# EAGLE schematic Resistor_Resistor (EAGLE 8.3.0), part 28 of 43
## Parts (continued)
R38638  10K  RESISTOR_0201  [0201]
R38639  10K  RESISTOR_0201  [0201]
R38640  10K  RESISTOR_0201  [0201]
R38641  10K  RESISTOR_0201  [0201]
R38642  10K  RESISTOR_0201  [0201]
R38643  10K  RESISTOR_0201  [0201]
R38644  10K  RESISTOR_0201  [0201]
R38645  10K  RESISTOR_0201  [0201]
R38646  10K  RESISTOR_0201  [0201]
R38647  10K  RESISTOR_0201  [0201]
R38648  10K  RESISTOR_0201  [0201]
R38649  10K  RESISTOR_0201  [0201]
R38650  10K  RESISTOR_0201  [0201]
R38651  10K  RESISTOR_0201  [0201]
R38652  10K  RESISTOR_0201  [0201]
R38653  10K  RESISTOR_0201  [0201]
R38654  10K  RESISTOR_0201  [0201]
R38655  10K  RESISTOR_0201  [0201]
R38656  10K  RESISTOR_0201  [0201]
R38657  10K  RESISTOR_0201  [0201]
R38658  10K  RESISTOR_0201  [0201]
R38659  10K  RESISTOR_0201  [0201]
R38660  10K  RESISTOR_0201  [0201]
R38661  10K  RESISTOR_0201  [0201]
R38662  10K  RESISTOR_0201  [0201]
R38663  10K  RESISTOR_0201  [0201]
R38664  10K  RESISTOR_0201  [0201]
R38665  10K  RESISTOR_0201  [0201]
R38666  10K  RESISTOR_0201  [0201]
R38667  10K  RESISTOR_0201  [0201]
R38668  10K  RESISTOR_0201  [0201]
R38669  10K  RESISTOR_0201  [0201]
R38670  10K  RESISTOR_0201  [0201]
R38671  10K  RESISTOR_0201  [0201]
R38672  10K  RESISTOR_0201  [0201]
R38673  10K  RESISTOR_0201  [0201]
R38674  10K  RESISTOR_0201  [0201]
R38675  10K  RESISTOR_0201  [0201]
R38676  10K  RESISTOR_0201  [0201]
R38677  10K  RESISTOR_0201  [0201]
R38678  10K  RESISTOR_0201  [0201]
R38679  10K  RESISTOR_0201  [0201]
R38680  10K  RESISTOR_0201  [0201]
R38681  10K  RESISTOR_0201  [0201]
R38682  10K  RESISTOR_0201  [0201]
R38683  10K  RESISTOR_0201  [0201]
R38684  10K  RESISTOR_0201  [0201]
R38685  10K  RESISTOR_0201  [0201]
R38686  10K  RESISTOR_0201  [0201]
R38687  10K  RESISTOR_0201  [0201]
R38688  10K  RESISTOR_0201  [0201]
R38689  10K  RESISTOR_0201  [0201]
R38690  10K  RESISTOR_0201  [0201]
R38691  10K  RESISTOR_0201  [0201]
R38692  10K  RESISTOR_0201  [0201]
R38693  10K  RESISTOR_0201  [0201]
R38694  10K  RESISTOR_0201  [0201]
R38695  10K  RESISTOR_0201  [0201]
R38696  10K  RESISTOR_0201  [0201]
R38697  10K  RESISTOR_0201  [0201]
R38698  10K  RESISTOR_0201  [0201]
R38699  10K  RESISTOR_0201  [0201]
R38700  10K  RESISTOR_0201  [0201]
R38701  10K  RESISTOR_0201  [0201]
R38702  10K  RESISTOR_0201  [0201]
R38703  10K  RESISTOR_0201  [0201]
R38704  10K  RESISTOR_0201  [0201]
R38705  10K  RESISTOR_0201  [0201]
R38706  10K  RESISTOR_0201  [0201]
R38707  10K  RESISTOR_0201  [0201]
R38708  10K  RESISTOR_0201  [0201]
R38709  10K  RESISTOR_0201  [0201]
R38710  10K  RESISTOR_0201  [0201]
R38711  10K  RESISTOR_0201  [0201]
R38712  10K  RESISTOR_0201  [0201]
R38713  10K  RESISTOR_0201  [0201]
R38714  10K  RESISTOR_0201  [0201]
R38715  10K  RESISTOR_0201  [0201]
R38716  10K  RESISTOR_0201  [0201]
R38717  10K  RESISTOR_0201  [0201]
R38718  10K  RESISTOR_0201  [0201]
R38719  10K  RESISTOR_0201  [0201]
R38720  10K  RESISTOR_0201  [0201]
R38721  10K  RESISTOR_0201  [0201]
R38722  10K  RESISTOR_0201  [0201]
R38723  10K  RESISTOR_0201  [0201]
R38724  10K  RESISTOR_0201  [0201]
R38725  10K  RESISTOR_0201  [0201]
R38726  10K  RESISTOR_0201  [0201]
R38727  10K  RESISTOR_0201  [0201]
R38728  10K  RESISTOR_0201  [0201]
R38729  10K  RESISTOR_0201  [0201]
R38730  10K  RESISTOR_0201  [0201]
R38731  10K  RESISTOR_0201  [0201]
R38732  10K  RESISTOR_0201  [0201]
R38733  10K  RESISTOR_0201  [0201]
R38734  10K  RESISTOR_0201  [0201]
R38735  10K  RESISTOR_0201  [0201]
R38736  10K  RESISTOR_0201  [0201]
R38737  10K  RESISTOR_0201  [0201]
R38738  10K  RESISTOR_0201  [0201]
R38739  10K  RESISTOR_0201  [0201]
R38740  10K  RESISTOR_0201  [0201]
R38741  10K  RESISTOR_0201  [0201]
R38742  10K  RESISTOR_0201  [0201]
R38743  10K  RESISTOR_0201  [0201]
R38744  10K  RESISTOR_0201  [0201]
R38745  10K  RESISTOR_0201  [0201]
R38746  10K  RESISTOR_0201  [0201]
R38747  10K  RESISTOR_0201  [0201]
R38748  10K  RESISTOR_0201  [0201]
R38749  10K  RESISTOR_0201  [0201]
R38750  10K  RESISTOR_0201  [0201]
R38751  10K  RESISTOR_0201  [0201]
R38752  10K  RESISTOR_0201  [0201]
R38753  10K  RESISTOR_0201  [0201]
R38754  10K  RESISTOR_0201  [0201]
R38755  10K  RESISTOR_0201  [0201]
R38756  10K  RESISTOR_0201  [0201]
R38757  10K  RESISTOR_0201  [0201]
R38758  10K  RESISTOR_0201  [0201]
R38759  10K  RESISTOR_0201  [0201]
R38760  10K  RESISTOR_0201  [0201]
R38761  10K  RESISTOR_0201  [0201]
R38762  10K  RESISTOR_0201  [0201]
R38763  10K  RESISTOR_0201  [0201]
R38764  10K  RESISTOR_0201  [0201]
R38765  10K  RESISTOR_0201  [0201]
R38766  10K  RESISTOR_0201  [0201]
R38767  10K  RESISTOR_0201  [0201]
R38768  10K  RESISTOR_0201  [0201]
R38769  10K  RESISTOR_0201  [0201]
R38770  10K  RESISTOR_0201  [0201]
R38771  10K  RESISTOR_0201  [0201]
R38772  10K  RESISTOR_0201  [0201]
R38773  10K  RESISTOR_0201  [0201]
R38774  10K  RESISTOR_0201  [0201]
R38775  10K  RESISTOR_0201  [0201]
R38776  10K  RESISTOR_0201  [0201]
R38777  10K  RESISTOR_0201  [0201]
R38778  10K  RESISTOR_0201  [0201]
R38779  10K  RESISTOR_0201  [0201]
R38780  10K  RESISTOR_0201  [0201]
R38781  10K  RESISTOR_0201  [0201]
R38782  10K  RESISTOR_0201  [0201]
R38783  10K  RESISTOR_0201  [0201]
R38784  10K  RESISTOR_0201  [0201]
R38785  10K  RESISTOR_0201  [0201]
R38786  10K  RESISTOR_0201  [0201]
R38787  10K  RESISTOR_0201  [0201]
R38788  10K  RESISTOR_0201  [0201]
R38789  10K  RESISTOR_0201  [0201]
R38790  10K  RESISTOR_0201  [0201]
R38791  10K  RESISTOR_0201  [0201]
R38792  10K  RESISTOR_0201  [0201]
R38793  10K  RESISTOR_0201  [0201]
R38794  10K  RESISTOR_0201  [0201]
R38795  10K  RESISTOR_0201  [0201]
R38796  10K  RESISTOR_0201  [0201]
R38797  10K  RESISTOR_0201  [0201]
R38798  10K  RESISTOR_0201  [0201]
R38799  10K  RESISTOR_0201  [0201]
R38800  10K  RESISTOR_0201  [0201]
R38801  10K  RESISTOR_0201  [0201]
R38802  10K  RESISTOR_0201  [0201]
R38803  10K  RESISTOR_0201  [0201]
R38804  10K  RESISTOR_0201  [0201]
R38805  10K  RESISTOR_0201  [0201]
R38806  10K  RESISTOR_0201  [0201]
R38807  10K  RESISTOR_0201  [0201]
R38808  10K  RESISTOR_0201  [0201]
R38809  10K  RESISTOR_0201  [0201]
R38810  10K  RESISTOR_0201  [0201]
R38811  10K  RESISTOR_0201  [0201]
R38812  10K  RESISTOR_0201  [0201]
R38813  10K  RESISTOR_0201  [0201]
R38814  10K  RESISTOR_0201  [0201]
R38815  10K  RESISTOR_0201  [0201]
R38816  10K  RESISTOR_0201  [0201]
R38817  10K  RESISTOR_0201  [0201]
R38818  10K  RESISTOR_0201  [0201]
R38819  10K  RESISTOR_0201  [0201]
R38820  10K  RESISTOR_0201  [0201]
R38821  10K  RESISTOR_0201  [0201]
R38822  10K  RESISTOR_0201  [0201]
R38823  10K  RESISTOR_0201  [0201]
R38824  10K  RESISTOR_0201  [0201]
R38825  10K  RESISTOR_0201  [0201]
R38826  10K  RESISTOR_0201  [0201]
R38827  10K  RESISTOR_0201  [0201]
R38828  10K  RESISTOR_0201  [0201]
R38829  10K  RESISTOR_0201  [0201]
R38830  10K  RESISTOR_0201  [0201]
R38831  10K  RESISTOR_0201  [0201]
R38832  10K  RESISTOR_0201  [0201]
R38833  10K  RESISTOR_0201  [0201]
R38834  10K  RESISTOR_0201  [0201]
R38835  10K  RESISTOR_0201  [0201]
R38836  10K  RESISTOR_0201  [0201]
R38837  10K  RESISTOR_0201  [0201]
R38838  10K  RESISTOR_0201  [0201]
R38839  10K  RESISTOR_0201  [0201]
R38840  10K  RESISTOR_0201  [0201]
R38841  10K  RESISTOR_0201  [0201]
R38842  10K  RESISTOR_0201  [0201]
R38843  10K  RESISTOR_0201  [0201]
R38844  10K  RESISTOR_0201  [0201]
R38845  10K  RESISTOR_0201  [0201]
R38846  10K  RESISTOR_0201  [0201]
R38847  10K  RESISTOR_0201  [0201]
R38848  10K  RESISTOR_0201  [0201]
R38849  10K  RESISTOR_0201  [0201]
R38850  10K  RESISTOR_0201  [0201]
R38851  10K  RESISTOR_0201  [0201]
R38852  10K  RESISTOR_0201  [0201]
R38853  10K  RESISTOR_0201  [0201]
R38854  10K  RESISTOR_0201  [0201]
R38855  10K  RESISTOR_0201  [0201]
R38856  10K  RESISTOR_0201  [0201]
R38857  10K  RESISTOR_0201  [0201]
R38858  10K  RESISTOR_0201  [0201]
R38859  10K  RESISTOR_0201  [0201]
R38860  10K  RESISTOR_0201  [0201]
R38861  10K  RESISTOR_0201  [0201]
R38862  10K  RESISTOR_0201  [0201]
R38863  10K  RESISTOR_0201  [0201]
R38864  10K  RESISTOR_0201  [0201]
R38865  10K  RESISTOR_0201  [0201]
R38866  10K  RESISTOR_0201  [0201]
R38867  10K  RESISTOR_0201  [0201]
R38868  10K  RESISTOR_0201  [0201]
R38869  10K  RESISTOR_0201  [0201]
R38870  10K  RESISTOR_0201  [0201]
R38871  10K  RESISTOR_0201  [0201]
R38872  10K  RESISTOR_0201  [0201]
R38873  10K  RESISTOR_0201  [0201]
R38874  10K  RESISTOR_0201  [0201]
R38875  10K  RESISTOR_0201  [0201]
R38876  10K  RESISTOR_0201  [0201]
R38877  10K  RESISTOR_0201  [0201]
R38878  10K  RESISTOR_0201  [0201]
R38879  10K  RESISTOR_0201  [0201]
R38880  10K  RESISTOR_0201  [0201]
R38881  10K  RESISTOR_0201  [0201]
R38882  10K  RESISTOR_0201  [0201]
R38883  10K  RESISTOR_0201  [0201]
R38884  10K  RESISTOR_0201  [0201]
R38885  10K  RESISTOR_0201  [0201]
R38886  10K  RESISTOR_0201  [0201]
R38887  10K  RESISTOR_0201  [0201]
R38888  10K  RESISTOR_0201  [0201]
R38889  10K  RESISTOR_0201  [0201]
R38890  10K  RESISTOR_0201  [0201]
R38891  10K  RESISTOR_0201  [0201]
R38892  10K  RESISTOR_0201  [0201]
R38893  10K  RESISTOR_0201  [0201]
R38894  10K  RESISTOR_0201  [0201]
R38895  10K  RESISTOR_0201  [0201]
R38896  10K  RESISTOR_0201  [0201]
R38897  10K  RESISTOR_0201  [0201]
R38898  10K  RESISTOR_0201  [0201]
R38899  10K  RESISTOR_0201  [0201]
R38900  10K  RESISTOR_0201  [0201]
R38901  10K  RESISTOR_0201  [0201]
R38902  10K  RESISTOR_0201  [0201]
R38903  10K  RESISTOR_0201  [0201]
R38904  10K  RESISTOR_0201  [0201]
R38905  10K  RESISTOR_0201  [0201]
R38906  10K  RESISTOR_0201  [0201]
R38907  10K  RESISTOR_0201  [0201]
R38908  10K  RESISTOR_0201  [0201]
R38909  10K  RESISTOR_0201  [0201]
R38910  10K  RESISTOR_0201  [0201]
R38911  10K  RESISTOR_0201  [0201]
R38912  10K  RESISTOR_0201  [0201]
R38913  10K  RESISTOR_0201  [0201]
R38914  10K  RESISTOR_0201  [0201]
R38915  10K  RESISTOR_0201  [0201]
R38916  10K  RESISTOR_0201  [0201]
R38917  10K  RESISTOR_0201  [0201]
R38918  10K  RESISTOR_0201  [0201]
R38919  10K  RESISTOR_0201  [0201]
R38920  10K  RESISTOR_0201  [0201]
R38921  10K  RESISTOR_0201  [0201]
R38922  10K  RESISTOR_0201  [0201]
R38923  10K  RESISTOR_0201  [0201]
R38924  10K  RESISTOR_0201  [0201]
R38925  10K  RESISTOR_0201  [0201]
R38926  10K  RESISTOR_0201  [0201]
R38927  10K  RESISTOR_0201  [0201]
R38928  10K  RESISTOR_0201  [0201]
R38929  10K  RESISTOR_0201  [0201]
R38930  10K  RESISTOR_0201  [0201]
R38931  10K  RESISTOR_0201  [0201]
R38932  10K  RESISTOR_0201  [0201]
R38933  10K  RESISTOR_0201  [0201]
R38934  10K  RESISTOR_0201  [0201]
R38935  10K  RESISTOR_0201  [0201]
R38936  10K  RESISTOR_0201  [0201]
R38937  10K  RESISTOR_0201  [0201]
R38938  10K  RESISTOR_0201  [0201]
R38939  10K  RESISTOR_0201  [0201]
R38940  10K  RESISTOR_0201  [0201]
R38941  10K  RESISTOR_0201  [0201]
R38942  10K  RESISTOR_0201  [0201]
R38943  10K  RESISTOR_0201  [0201]
R38944  10K  RESISTOR_0201  [0201]
R38945  10K  RESISTOR_0201  [0201]
R38946  10K  RESISTOR_0201  [0201]
R38947  10K  RESISTOR_0201  [0201]
R38948  10K  RESISTOR_0201  [0201]
R38949  10K  RESISTOR_0201  [0201]
R38950  10K  RESISTOR_0201  [0201]
R38951  10K  RESISTOR_0201  [0201]
R38952  10K  RESISTOR_0201  [0201]
R38953  10K  RESISTOR_0201  [0201]
R38954  10K  RESISTOR_0201  [0201]
R38955  10K  RESISTOR_0201  [0201]
R38956  10K  RESISTOR_0201  [0201]
R38957  10K  RESISTOR_0201  [0201]
R38958  10K  RESISTOR_0201  [0201]
R38959  10K  RESISTOR_0201  [0201]
R38960  10K  RESISTOR_0201  [0201]
R38961  10K  RESISTOR_0201  [0201]
R38962  10K  RESISTOR_0201  [0201]
R38963  10K  RESISTOR_0201  [0201]
R38964  10K  RESISTOR_0201  [0201]
R38965  10K  RESISTOR_0201  [0201]
R38966  10K  RESISTOR_0201  [0201]
R38967  10K  RESISTOR_0201  [0201]
R38968  10K  RESISTOR_0201  [0201]
R38969  10K  RESISTOR_0201  [0201]
R38970  10K  RESISTOR_0201  [0201]
R38971  10K  RESISTOR_0201  [0201]
R38972  10K  RESISTOR_0201  [0201]
R38973  10K  RESISTOR_0201  [0201]
R38974  10K  RESISTOR_0201  [0201]
R38975  10K  RESISTOR_0201  [0201]
R38976  10K  RESISTOR_0201  [0201]
R38977  10K  RESISTOR_0201  [0201]
R38978  10K  RESISTOR_0201  [0201]
R38979  10K  RESISTOR_0201  [0201]
R38980  10K  RESISTOR_0201  [0201]
R38981  10K  RESISTOR_0201  [0201]
R38982  10K  RESISTOR_0201  [0201]
R38983  10K  RESISTOR_0201  [0201]
R38984  10K  RESISTOR_0201  [0201]
R38985  10K  RESISTOR_0201  [0201]
R38986  10K  RESISTOR_0201  [0201]
R38987  10K  RESISTOR_0201  [0201]
R38988  10K  RESISTOR_0201  [0201]
R38989  10K  RESISTOR_0201  [0201]
R38990  10K  RESISTOR_0201  [0201]
R38991  10K  RESISTOR_0201  [0201]
R38992  10K  RESISTOR_0201  [0201]
R38993  10K  RESISTOR_0201  [0201]
R38994  10K  RESISTOR_0201  [0201]
R38995  10K  RESISTOR_0201  [0201]
R38996  10K  RESISTOR_0201  [0201]
R38997  10K  RESISTOR_0201  [0201]
R38998  10K  RESISTOR_0201  [0201]
R38999  10K  RESISTOR_0201  [0201]
R39000  10K  RESISTOR_0201  [0201]
R39001  10K  RESISTOR_0201  [0201]
R39002  10K  RESISTOR_0201  [0201]
R39003  10K  RESISTOR_0201  [0201]
R39004  10K  RESISTOR_0201  [0201]
R39005  10K  RESISTOR_0201  [0201]
R39006  10K  RESISTOR_0201  [0201]
R39007  10K  RESISTOR_0201  [0201]
R39008  10K  RESISTOR_0201  [0201]
R39009  10K  RESISTOR_0201  [0201]
R39010  10K  RESISTOR_0201  [0201]
R39011  10K  RESISTOR_0201  [0201]
R39012  10K  RESISTOR_0201  [0201]
R39013  10K  RESISTOR_0201  [0201]
R39014  10K  RESISTOR_0201  [0201]
R39015  10K  RESISTOR_0201  [0201]
R39016  10K  RESISTOR_0201  [0201]
R39017  10K  RESISTOR_0201  [0201]
R39018  10K  RESISTOR_0201  [0201]
R39019  10K  RESISTOR_0201  [0201]
R39020  10K  RESISTOR_0201  [0201]
R39021  10K  RESISTOR_0201  [0201]
R39022  10K  RESISTOR_0201  [0201]
R39023  10K  RESISTOR_0201  [0201]
R39024  10K  RESISTOR_0201  [0201]
R39025  10K  RESISTOR_0201  [0201]
R39026  10K  RESISTOR_0201  [0201]
R39027  10K  RESISTOR_0201  [0201]
R39028  10K  RESISTOR_0201  [0201]
R39029  10K  RESISTOR_0201  [0201]
R39030  10K  RESISTOR_0201  [0201]
R39031  10K  RESISTOR_0201  [0201]
R39032  10K  RESISTOR_0201  [0201]
R39033  10K  RESISTOR_0201  [0201]
R39034  10K  RESISTOR_0201  [0201]
R39035  10K  RESISTOR_0201  [0201]
R39036  10K  RESISTOR_0201  [0201]
R39037  10K  RESISTOR_0201  [0201]
R39038  10K  RESISTOR_0201  [0201]
R39039  10K  RESISTOR_0201  [0201]
R39040  10K  RESISTOR_0201  [0201]
R39041  10K  RESISTOR_0201  [0201]
R39042  10K  RESISTOR_0201  [0201]
R39043  10K  RESISTOR_0201  [0201]
R39044  10K  RESISTOR_0201  [0201]
R39045  10K  RESISTOR_0201  [0201]
R39046  10K  RESISTOR_0201  [0201]
R39047  10K  RESISTOR_0201  [0201]
R39048  10K  RESISTOR_0201  [0201]
R39049  10K  RESISTOR_0201  [0201]
R39050  10K  RESISTOR_0201  [0201]
R39051  10K  RESISTOR_0201  [0201]
R39052  10K  RESISTOR_0201  [0201]
R39053  10K  RESISTOR_0201  [0201]
R39054  10K  RESISTOR_0201  [0201]
R39055  10K  RESISTOR_0201  [0201]
R39056  10K  RESISTOR_0201  [0201]
R39057  10K  RESISTOR_0201  [0201]
R39058  10K  RESISTOR_0201  [0201]
R39059  10K  RESISTOR_0201  [0201]
R39060  10K  RESISTOR_0201  [0201]
R39061  10K  RESISTOR_0201  [0201]
R39062  10K  RESISTOR_0201  [0201]
R39063  10K  RESISTOR_0201  [0201]
R39064  10K  RESISTOR_0201  [0201]
R39065  10K  RESISTOR_0201  [0201]
R39066  10K  RESISTOR_0201  [0201]
R39067  10K  RESISTOR_0201  [0201]
R39068  10K  RESISTOR_0201  [0201]
R39069  10K  RESISTOR_0201  [0201]
R39070  10K  RESISTOR_0201  [0201]
R39071  10K  RESISTOR_0201  [0201]
R39072  10K  RESISTOR_0201  [0201]
R39073  10K  RESISTOR_0201  [0201]
R39074  10K  RESISTOR_0201  [0201]
R39075  10K  RESISTOR_0201  [0201]
R39076  10K  RESISTOR_0201  [0201]
R39077  10K  RESISTOR_0201  [0201]
R39078  10K  RESISTOR_0201  [0201]
R39079  10K  RESISTOR_0201  [0201]
R39080  10K  RESISTOR_0201  [0201]
R39081  10K  RESISTOR_0201  [0201]
R39082  10K  RESISTOR_0201  [0201]
R39083  10K  RESISTOR_0201  [0201]
R39084  10K  RESISTOR_0201  [0201]
R39085  10K  RESISTOR_0201  [0201]
R39086  10K  RESISTOR_0201  [0201]
R39087  10K  RESISTOR_0201  [0201]
R39088  10K  RESISTOR_0201  [0201]
R39089  10K  RESISTOR_0201  [0201]
R39090  10K  RESISTOR_0201  [0201]
R39091  10K  RESISTOR_0201  [0201]
R39092  10K  RESISTOR_0201  [0201]
R39093  10K  RESISTOR_0201  [0201]
R39094  10K  RESISTOR_0201  [0201]
R39095  10K  RESISTOR_0201  [0201]
R39096  10K  RESISTOR_0201  [0201]
R39097  10K  RESISTOR_0201  [0201]
R39098  10K  RESISTOR_0201  [0201]
R39099  10K  RESISTOR_0201  [0201]
R39100  10K  RESISTOR_0201  [0201]
R39101  10K  RESISTOR_0201  [0201]
R39102  10K  RESISTOR_0201  [0201]
R39103  10K  RESISTOR_0201  [0201]
R39104  10K  RESISTOR_0201  [0201]
R39105  10K  RESISTOR_0201  [0201]
R39106  10K  RESISTOR_0201  [0201]
R39107  10K  RESISTOR_0201  [0201]
R39108  10K  RESISTOR_0201  [0201]
R39109  10K  RESISTOR_0201  [0201]
R39110  10K  RESISTOR_0201  [0201]
R39111  10K  RESISTOR_0201  [0201]
R39112  10K  RESISTOR_0201  [0201]
R39113  10K  RESISTOR_0201  [0201]
R39114  10K  RESISTOR_0201  [0201]
R39115  10K  RESISTOR_0201  [0201]
R39116  10K  RESISTOR_0201  [0201]
R39117  10K  RESISTOR_0201  [0201]
R39118  10K  RESISTOR_0201  [0201]
R39119  10K  RESISTOR_0201  [0201]
R39120  10K  RESISTOR_0201  [0201]
R39121  10K  RESISTOR_0201  [0201]
R39122  10K  RESISTOR_0201  [0201]
R39123  10K  RESISTOR_0201  [0201]
R39124  10K  RESISTOR_0201  [0201]
R39125  10K  RESISTOR_0201  [0201]
R39126  10K  RESISTOR_0201  [0201]
R39127  10K  RESISTOR_0201  [0201]
R39128  10K  RESISTOR_0201  [0201]
R39129  10K  RESISTOR_0201  [0201]
R39130  10K  RESISTOR_0201  [0201]
R39131  10K  RESISTOR_0201  [0201]
R39132  10K  RESISTOR_0201  [0201]
R39133  10K  RESISTOR_0201  [0201]
R39134  10K  RESISTOR_0201  [0201]
R39135  10K  RESISTOR_0201  [0201]
R39136  10K  RESISTOR_0201  [0201]
R39137  10K  RESISTOR_0201  [0201]
R39138  10K  RESISTOR_0201  [0201]
R39139  10K  RESISTOR_0201  [0201]
R39140  10K  RESISTOR_0201  [0201]
R39141  10K  RESISTOR_0201  [0201]
R39142  10K  RESISTOR_0201  [0201]
R39143  10K  RESISTOR_0201  [0201]
R39144  10K  RESISTOR_0201  [0201]
R39145  10K  RESISTOR_0201  [0201]
R39146  10K  RESISTOR_0201  [0201]
R39147  10K  RESISTOR_0201  [0201]
R39148  10K  RESISTOR_0201  [0201]
R39149  10K  RESISTOR_0201  [0201]
R39150  10K  RESISTOR_0201  [0201]
R39151  10K  RESISTOR_0201  [0201]
R39152  10K  RESISTOR_0201  [0201]
R39153  10K  RESISTOR_0201  [0201]
R39154  10K  RESISTOR_0201  [0201]
R39155  10K  RESISTOR_0201  [0201]
R39156  10K  RESISTOR_0201  [0201]
R39157  10K  RESISTOR_0201  [0201]
R39158  10K  RESISTOR_0201  [0201]
R39159  10K  RESISTOR_0201  [0201]
R39160  10K  RESISTOR_0201  [0201]
R39161  10K  RESISTOR_0201  [0201]
R39162  10K  RESISTOR_0201  [0201]
R39163  10K  RESISTOR_0201  [0201]
R39164  10K  RESISTOR_0201  [0201]
R39165  10K  RESISTOR_0201  [0201]
R39166  10K  RESISTOR_0201  [0201]
R39167  10K  RESISTOR_0201  [0201]
R39168  10K  RESISTOR_0201  [0201]
R39169  10K  RESISTOR_0201  [0201]
R39170  10K  RESISTOR_0201  [0201]
R39171  10K  RESISTOR_0201  [0201]
R39172  10K  RESISTOR_0201  [0201]
R39173  10K  RESISTOR_0201  [0201]
R39174  10K  RESISTOR_0201  [0201]
R39175  10K  RESISTOR_0201  [0201]
R39176  10K  RESISTOR_0201  [0201]
R39177  10K  RESISTOR_0201  [0201]
R39178  10K  RESISTOR_0201  [0201]
R39179  10K  RESISTOR_0201  [0201]
R39180  10K  RESISTOR_0201  [0201]
R39181  10K  RESISTOR_0201  [0201]
R39182  10K  RESISTOR_0201  [0201]
R39183  10K  RESISTOR_0201  [0201]
R39184  10K  RESISTOR_0201  [0201]
R39185  10K  RESISTOR_0201  [0201]
R39186  10K  RESISTOR_0201  [0201]
R39187  10K  RESISTOR_0201  [0201]
R39188  10K  RESISTOR_0201  [0201]
R39189  10K  RESISTOR_0201  [0201]
R39190  10K  RESISTOR_0201  [0201]
R39191  10K  RESISTOR_0201  [0201]
R39192  10K  RESISTOR_0201  [0201]
R39193  10K  RESISTOR_0201  [0201]
R39194  10K  RESISTOR_0201  [0201]
R39195  10K  RESISTOR_0201  [0201]
R39196  10K  RESISTOR_0201  [0201]
R39197  10K  RESISTOR_0201  [0201]
R39198  10K  RESISTOR_0201  [0201]
R39199  10K  RESISTOR_0201  [0201]
R39200  10K  RESISTOR_0201  [0201]
R39201  10K  RESISTOR_0201  [0201]
R39202  10K  RESISTOR_0201  [0201]
R39203  10K  RESISTOR_0201  [0201]
R39204  10K  RESISTOR_0201  [0201]
R39205  10K  RESISTOR_0201  [0201]
R39206  10K  RESISTOR_0201  [0201]
R39207  10K  RESISTOR_0201  [0201]
R39208  10K  RESISTOR_0201  [0201]
R39209  10K  RESISTOR_0201  [0201]
R39210  10K  RESISTOR_0201  [0201]
R39211  10K  RESISTOR_0201  [0201]
R39212  10K  RESISTOR_0201  [0201]
R39213  10K  RESISTOR_0201  [0201]
R39214  10K  RESISTOR_0201  [0201]
R39215  10K  RESISTOR_0201  [0201]
R39216  10K  RESISTOR_0201  [0201]
R39217  10K  RESISTOR_0201  [0201]
R39218  10K  RESISTOR_0201  [0201]
R39219  10K  RESISTOR_0201  [0201]
R39220  10K  RESISTOR_0201  [0201]
R39221  10K  RESISTOR_0201  [0201]
R39222  10K  RESISTOR_0201  [0201]
R39223  10K  RESISTOR_0201  [0201]
R39224  10K  RESISTOR_0201  [0201]
R39225  10K  RESISTOR_0201  [0201]
R39226  10K  RESISTOR_0201  [0201]
R39227  10K  RESISTOR_0201  [0201]
R39228  10K  RESISTOR_0201  [0201]
R39229  10K  RESISTOR_0201  [0201]
R39230  10K  RESISTOR_0201  [0201]
R39231  10K  RESISTOR_0201  [0201]
R39232  10K  RESISTOR_0201  [0201]
R39233  10K  RESISTOR_0201  [0201]
R39234  10K  RESISTOR_0201  [0201]
R39235  10K  RESISTOR_0201  [0201]
R39236  10K  RESISTOR_0201  [0201]
R39237  10K  RESISTOR_0201  [0201]
R39238  10K  RESISTOR_0201  [0201]
R39239  10K  RESISTOR_0201  [0201]
R39240  10K  RESISTOR_0201  [0201]
R39241  10K  RESISTOR_0201  [0201]
R39242  10K  RESISTOR_0201  [0201]
R39243  10K  RESISTOR_0201  [0201]
R39244  10K  RESISTOR_0201  [0201]
R39245  10K  RESISTOR_0201  [0201]
R39246  10K  RESISTOR_0201  [0201]
R39247  10K  RESISTOR_0201  [0201]
R39248  10K  RESISTOR_0201  [0201]
R39249  10K  RESISTOR_0201  [0201]
R39250  10K  RESISTOR_0201  [0201]
R39251  10K  RESISTOR_0201  [0201]
R39252  10K  RESISTOR_0201  [0201]
R39253  10K  RESISTOR_0201  [0201]
R39254  10K  RESISTOR_0201  [0201]
R39255  10K  RESISTOR_0201  [0201]
R39256  10K  RESISTOR_0201  [0201]
R39257  10K  RESISTOR_0201  [0201]
R39258  10K  RESISTOR_0201  [0201]
R39259  10K  RESISTOR_0201  [0201]
R39260  10K  RESISTOR_0201  [0201]
R39261  10K  RESISTOR_0201  [0201]
R39262  10K  RESISTOR_0201  [0201]
R39263  10K  RESISTOR_0201  [0201]
R39264  10K  RESISTOR_0201  [0201]
R39265  10K  RESISTOR_0201  [0201]
R39266  10K  RESISTOR_0201  [0201]
R39267  10K  RESISTOR_0201  [0201]
R39268  10K  RESISTOR_0201  [0201]
R39269  10K  RESISTOR_0201  [0201]
R39270  10K  RESISTOR_0201  [0201]
R39271  10K  RESISTOR_0201  [0201]
R39272  10K  RESISTOR_0201  [0201]
R39273  10K  RESISTOR_0201  [0201]
R39274  10K  RESISTOR_0201  [0201]
R39275  10K  RESISTOR_0201  [0201]
R39276  10K  RESISTOR_0201  [0201]
R39277  10K  RESISTOR_0201  [0201]
R39278  10K  RESISTOR_0201  [0201]
R39279  10K  RESISTOR_0201  [0201]
R39280  10K  RESISTOR_0201  [0201]
R39281  10K  RESISTOR_0201  [0201]
R39282  10K  RESISTOR_0201  [0201]
R39283  10K  RESISTOR_0201  [0201]
R39284  10K  RESISTOR_0201  [0201]
R39285  10K  RESISTOR_0201  [0201]
R39286  10K  RESISTOR_0201  [0201]
R39287  10K  RESISTOR_0201  [0201]
R39288  10K  RESISTOR_0201  [0201]
R39289  10K  RESISTOR_0201  [0201]
R39290  10K  RESISTOR_0201  [0201]
R39291  10K  RESISTOR_0201  [0201]
R39292  10K  RESISTOR_0201  [0201]
R39293  10K  RESISTOR_0201  [0201]
R39294  10K  RESISTOR_0201  [0201]
R39295  10K  RESISTOR_0201  [0201]
R39296  10K  RESISTOR_0201  [0201]
R39297  10K  RESISTOR_0201  [0201]
R39298  10K  RESISTOR_0201  [0201]
R39299  10K  RESISTOR_0201  [0201]
R39300  10K  RESISTOR_0201  [0201]
R39301  10K  RESISTOR_0201  [0201]
R39302  10K  RESISTOR_0201  [0201]
R39303  10K  RESISTOR_0201  [0201]
R39304  10K  RESISTOR_0201  [0201]
R39305  10K  RESISTOR_0201  [0201]
R39306  10K  RESISTOR_0201  [0201]
R39307  10K  RESISTOR_0201  [0201]
R39308  10K  RESISTOR_0201  [0201]
R39309  10K  RESISTOR_0201  [0201]
R39310  10K  RESISTOR_0201  [0201]
R39311  10K  RESISTOR_0201  [0201]
R39312  10K  RESISTOR_0201  [0201]
R39313  10K  RESISTOR_0201  [0201]
R39314  10K  RESISTOR_0201  [0201]
R39315  10K  RESISTOR_0201  [0201]
R39316  10K  RESISTOR_0201  [0201]
R39317  10K  RESISTOR_0201  [0201]
R39318  10K  RESISTOR_0201  [0201]
R39319  10K  RESISTOR_0201  [0201]
R39320  10K  RESISTOR_0201  [0201]
R39321  10K  RESISTOR_0201  [0201]
R39322  10K  RESISTOR_0201  [0201]
R39323  10K  RESISTOR_0201  [0201]
R39324  10K  RESISTOR_0201  [0201]
R39325  10K  RESISTOR_0201  [0201]
R39326  10K  RESISTOR_0201  [0201]
R39327  10K  RESISTOR_0201  [0201]
R39328  10K  RESISTOR_0201  [0201]
R39329  10K  RESISTOR_0201  [0201]
R39330  10K  RESISTOR_0201  [0201]
R39331  10K  RESISTOR_0201  [0201]
R39332  10K  RESISTOR_0201  [0201]
R39333  10K  RESISTOR_0201  [0201]
R39334  10K  RESISTOR_0201  [0201]
R39335  10K  RESISTOR_0201  [0201]
R39336  10K  RESISTOR_0201  [0201]
R39337  10K  RESISTOR_0201  [0201]
R39338  10K  RESISTOR_0201  [0201]
R39339  10K  RESISTOR_0201  [0201]
R39340  10K  RESISTOR_0201  [0201]
R39341  10K  RESISTOR_0201  [0201]
R39342  10K  RESISTOR_0201  [0201]
R39343  10K  RESISTOR_0201  [0201]
R39344  10K  RESISTOR_0201  [0201]
R39345  10K  RESISTOR_0201  [0201]
R39346  10K  RESISTOR_0201  [0201]
R39347  10K  RESISTOR_0201  [0201]
R39348  10K  RESISTOR_0201  [0201]
R39349  10K  RESISTOR_0201  [0201]
R39350  10K  RESISTOR_0201  [0201]
R39351  10K  RESISTOR_0201  [0201]
R39352  10K  RESISTOR_0201  [0201]
R39353  10K  RESISTOR_0201  [0201]
R39354  10K  RESISTOR_0201  [0201]
R39355  10K  RESISTOR_0201  [0201]
R39356  10K  RESISTOR_0201  [0201]
R39357  10K  RESISTOR_0201  [0201]
R39358  10K  RESISTOR_0201  [0201]
R39359  10K  RESISTOR_0201  [0201]
R39360  10K  RESISTOR_0201  [0201]
R39361  10K  RESISTOR_0201  [0201]
R39362  10K  RESISTOR_0201  [0201]
R39363  10K  RESISTOR_0201  [0201]
R39364  10K  RESISTOR_0201  [0201]
R39365  10K  RESISTOR_0201  [0201]
R39366  10K  RESISTOR_0201  [0201]
R39367  10K  RESISTOR_0201  [0201]
R39368  10K  RESISTOR_0201  [0201]
R39369  10K  RESISTOR_0201  [0201]
R39370  10K  RESISTOR_0201  [0201]
R39371  10K  RESISTOR_0201  [0201]
R39372  10K  RESISTOR_0201  [0201]
R39373  10K  RESISTOR_0201  [0201]
R39374  10K  RESISTOR_0201  [0201]
R39375  10K  RESISTOR_0201  [0201]
R39376  10K  RESISTOR_0201  [0201]
R39377  10K  RESISTOR_0201  [0201]
R39378  10K  RESISTOR_0201  [0201]
R39379  10K  RESISTOR_0201  [0201]
R39380  10K  RESISTOR_0201  [0201]
R39381  10K  RESISTOR_0201  [0201]
R39382  10K  RESISTOR_0201  [0201]
R39383  10K  RESISTOR_0201  [0201]
R39384  10K  RESISTOR_0201  [0201]
R39385  10K  RESISTOR_0201  [0201]
R39386  10K  RESISTOR_0201  [0201]
R39387  10K  RESISTOR_0201  [0201]
R39388  10K  RESISTOR_0201  [0201]
R39389  10K  RESISTOR_0201  [0201]
R39390  10K  RESISTOR_0201  [0201]
R39391  10K  RESISTOR_0201  [0201]
R39392  10K  RESISTOR_0201  [0201]
R39393  10K  RESISTOR_0201  [0201]
R39394  10K  RESISTOR_0201  [0201]
R39395  10K  RESISTOR_0201  [0201]
R39396  10K  RESISTOR_0201  [0201]
R39397  10K  RESISTOR_0201  [0201]
R39398  10K  RESISTOR_0201  [0201]
R39399  10K  RESISTOR_0201  [0201]
R39400  10K  RESISTOR_0201  [0201]
R39401  10K  RESISTOR_0201  [0201]
R39402  10K  RESISTOR_0201  [0201]
R39403  10K  RESISTOR_0201  [0201]
R39404  10K  RESISTOR_0201  [0201]
R39405  10K  RESISTOR_0201  [0201]
R39406  10K  RESISTOR_0201  [0201]
R39407  10K  RESISTOR_0201  [0201]
R39408  10K  RESISTOR_0201  [0201]
R39409  10K  RESISTOR_0201  [0201]
R39410  10K  RESISTOR_0201  [0201]
R39411  10K  RESISTOR_0201  [0201]
R39412  10K  RESISTOR_0201  [0201]
R39413  10K  RESISTOR_0201  [0201]
R39414  10K  RESISTOR_0201  [0201]
R39415  10K  RESISTOR_0201  [0201]
R39416  10K  RESISTOR_0201  [0201]
R39417  10K  RESISTOR_0201  [0201]
R39418  10K  RESISTOR_0201  [0201]
R39419  10K  RESISTOR_0201  [0201]
R39420  10K  RESISTOR_0201  [0201]
R39421  10K  RESISTOR_0201  [0201]
R39422  10K  RESISTOR_0201  [0201]
R39423  10K  RESISTOR_0201  [0201]
R39424  10K  RESISTOR_0201  [0201]
R39425  10K  RESISTOR_0201  [0201]
R39426  10K  RESISTOR_0201  [0201]
R39427  10K  RESISTOR_0201  [0201]
R39428  10K  RESISTOR_0201  [0201]
R39429  10K  RESISTOR_0201  [0201]
R39430  10K  RESISTOR_0201  [0201]
R39431  10K  RESISTOR_0201  [0201]
R39432  10K  RESISTOR_0201  [0201]
R39433  10K  RESISTOR_0201  [0201]
R39434  10K  RESISTOR_0201  [0201]
R39435  10K  RESISTOR_0201  [0201]
R39436  10K  RESISTOR_0201  [0201]
R39437  10K  RESISTOR_0201  [0201]
R39438  10K  RESISTOR_0201  [0201]
R39439  10K  RESISTOR_0201  [0201]
R39440  10K  RESISTOR_0201  [0201]
R39441  10K  RESISTOR_0201  [0201]
R39442  10K  RESISTOR_0201  [0201]
R39443  10K  RESISTOR_0201  [0201]
R39444  10K  RESISTOR_0201  [0201]
R39445  10K  RESISTOR_0201  [0201]
R39446  10K  RESISTOR_0201  [0201]
R39447  10K  RESISTOR_0201  [0201]
R39448  10K  RESISTOR_0201  [0201]
R39449  10K  RESISTOR_0201  [0201]
R39450  10K  RESISTOR_0201  [0201]
R39451  10K  RESISTOR_0201  [0201]
R39452  10K  RESISTOR_0201  [0201]
R39453  10K  RESISTOR_0201  [0201]
R39454  10K  RESISTOR_0201  [0201]
R39455  10K  RESISTOR_0201  [0201]
R39456  10K  RESISTOR_0201  [0201]
R39457  10K  RESISTOR_0201  [0201]
R39458  10K  RESISTOR_0201  [0201]
R39459  10K  RESISTOR_0201  [0201]
R39460  10K  RESISTOR_0201  [0201]
R39461  10K  RESISTOR_0201  [0201]
R39462  10K  RESISTOR_0201  [0201]
R39463  10K  RESISTOR_0201  [0201]
R39464  10K  RESISTOR_0201  [0201]
R39465  10K  RESISTOR_0201  [0201]
R39466  10K  RESISTOR_0201  [0201]
R39467  10K  RESISTOR_0201  [0201]
R39468  10K  RESISTOR_0201  [0201]
R39469  10K  RESISTOR_0201  [0201]
R39470  10K  RESISTOR_0201  [0201]
R39471  10K  RESISTOR_0201  [0201]
R39472  10K  RESISTOR_0201  [0201]
R39473  10K  RESISTOR_0201  [0201]
R39474  10K  RESISTOR_0201  [0201]
R39475  10K  RESISTOR_0201  [0201]
R39476  10K  RESISTOR_0201  [0201]
R39477  10K  RESISTOR_0201  [0201]
R39478  10K  RESISTOR_0201  [0201]
R39479  10K  RESISTOR_0201  [0201]
R39480  10K  RESISTOR_0201  [0201]
R39481  10K  RESISTOR_0201  [0201]
R39482  10K  RESISTOR_0201  [0201]
R39483  10K  RESISTOR_0201  [0201]
R39484  10K  RESISTOR_0201  [0201]
R39485  10K  RESISTOR_0201  [0201]
R39486  10K  RESISTOR_0201  [0201]
R39487  10K  RESISTOR_0201  [0201]
R39488  10K  RESISTOR_0201  [0201]
R39489  10K  RESISTOR_0201  [0201]
R39490  10K  RESISTOR_0201  [0201]
R39491  10K  RESISTOR_0201  [0201]
R39492  10K  RESISTOR_0201  [0201]
R39493  10K  RESISTOR_0201  [0201]
R39494  10K  RESISTOR_0201  [0201]
R39495  10K  RESISTOR_0201  [0201]
R39496  10K  RESISTOR_0201  [0201]
R39497  10K  RESISTOR_0201  [0201]
R39498  10K  RESISTOR_0201  [0201]
R39499  10K  RESISTOR_0201  [0201]
R39500  10K  RESISTOR_0201  [0201]
R39501  10K  RESISTOR_0201  [0201]
R39502  10K  RESISTOR_0201  [0201]
R39503  10K  RESISTOR_0201  [0201]
R39504  10K  RESISTOR_0201  [0201]
R39505  10K  RESISTOR_0201  [0201]
R39506  10K  RESISTOR_0201  [0201]
R39507  10K  RESISTOR_0201  [0201]
R39508  10K  RESISTOR_0201  [0201]
R39509  10K  RESISTOR_0201  [0201]
R39510  10K  RESISTOR_0201  [0201]
R39511  10K  RESISTOR_0201  [0201]
R39512  10K  RESISTOR_0201  [0201]
R39513  10K  RESISTOR_0201  [0201]
R39514  10K  RESISTOR_0201  [0201]
R39515  10K  RESISTOR_0201  [0201]
R39516  10K  RESISTOR_0201  [0201]
R39517  10K  RESISTOR_0201  [0201]
R39518  10K  RESISTOR_0201  [0201]
R39519  10K  RESISTOR_0201  [0201]
R39520  10K  RESISTOR_0201  [0201]
R39521  10K  RESISTOR_0201  [0201]
R39522  10K  RESISTOR_0201  [0201]
R39523  10K  RESISTOR_0201  [0201]
R39524  10K  RESISTOR_0201  [0201]
R39525  10K  RESISTOR_0201  [0201]
R39526  10K  RESISTOR_0201  [0201]
R39527  10K  RESISTOR_0201  [0201]
R39528  10K  RESISTOR_0201  [0201]
R39529  10K  RESISTOR_0201  [0201]
R39530  10K  RESISTOR_0201  [0201]
R39531  10K  RESISTOR_0201  [0201]
R39532  10K  RESISTOR_0201  [0201]
R39533  10K  RESISTOR_0201  [0201]
R39534  10K  RESISTOR_0201  [0201]
R39535  10K  RESISTOR_0201  [0201]
R39536  10K  RESISTOR_0201  [0201]
R39537  10K  RESISTOR_0201  [0201]
R39538  10K  RESISTOR_0201  [0201]
R39539  10K  RESISTOR_0201  [0201]
R39540  10K  RESISTOR_0201  [0201]
R39541  10K  RESISTOR_0201  [0201]
R39542  10K  RESISTOR_0201  [0201]
R39543  10K  RESISTOR_0201  [0201]
R39544  10K  RESISTOR_0201  [0201]
R39545  10K  RESISTOR_0201  [0201]
R39546  10K  RESISTOR_0201  [0201]
R39547  10K  RESISTOR_0201  [0201]
R39548  10K  RESISTOR_0201  [0201]
R39549  10K  RESISTOR_0201  [0201]
R39550  10K  RESISTOR_0201  [0201]
R39551  10K  RESISTOR_0201  [0201]
R39552  10K  RESISTOR_0201  [0201]
R39553  10K  RESISTOR_0201  [0201]
R39554  10K  RESISTOR_0201  [0201]
R39555  10K  RESISTOR_0201  [0201]
R39556  10K  RESISTOR_0201  [0201]
R39557  10K  RESISTOR_0201  [0201]
R39558  10K  RESISTOR_0201  [0201]
R39559  10K  RESISTOR_0201  [0201]
R39560  10K  RESISTOR_0201  [0201]
R39561  10K  RESISTOR_0201  [0201]
R39562  10K  RESISTOR_0201  [0201]
R39563  10K  RESISTOR_0201  [0201]
R39564  10K  RESISTOR_0201  [0201]
R39565  10K  RESISTOR_0201  [0201]
R39566  10K  RESISTOR_0201  [0201]
R39567  10K  RESISTOR_0201  [0201]
R39568  10K  RESISTOR_0201  [0201]
R39569  10K  RESISTOR_0201  [0201]
R39570  10K  RESISTOR_0201  [0201]
R39571  10K  RESISTOR_0201  [0201]
R39572  10K  RESISTOR_0201  [0201]
R39573  10K  RESISTOR_0201  [0201]
R39574  10K  RESISTOR_0201  [0201]
R39575  10K  RESISTOR_0201  [0201]
R39576  10K  RESISTOR_0201  [0201]
R39577  10K  RESISTOR_0201  [0201]
R39578  10K  RESISTOR_0201  [0201]
R39579  10K  RESISTOR_0201  [0201]
R39580  10K  RESISTOR_0201  [0201]
R39581  10K  RESISTOR_0201  [0201]
R39582  10K  RESISTOR_0201  [0201]
R39583  10K  RESISTOR_0201  [0201]
R39584  10K  RESISTOR_0201  [0201]
R39585  10K  RESISTOR_0201  [0201]
R39586  10K  RESISTOR_0201  [0201]
R39587  10K  RESISTOR_0201  [0201]
R39588  10K  RESISTOR_0201  [0201]
R39589  10K  RESISTOR_0201  [0201]
R39590  10K  RESISTOR_0201  [0201]
R39591  10K  RESISTOR_0201  [0201]
R39592  10K  RESISTOR_0201  [0201]
R39593  10K  RESISTOR_0201  [0201]
R39594  10K  RESISTOR_0201  [0201]
R39595  10K  RESISTOR_0201  [0201]
R39596  10K  RESISTOR_0201  [0201]
R39597  10K  RESISTOR_0201  [0201]
R39598  10K  RESISTOR_0201  [0201]
R39599  10K  RESISTOR_0201  [0201]
R39600  10K  RESISTOR_0201  [0201]
R39601  10K  RESISTOR_0201  [0201]
R39602  10K  RESISTOR_0201  [0201]
R39603  10K  RESISTOR_0201  [0201]
R39604  10K  RESISTOR_0201  [0201]
R39605  10K  RESISTOR_0201  [0201]
R39606  10K  RESISTOR_0201  [0201]
R39607  10K  RESISTOR_0201  [0201]
R39608  10K  RESISTOR_0201  [0201]
R39609  10K  RESISTOR_0201  [0201]
R39610  10K  RESISTOR_0201  [0201]
R39611  10K  RESISTOR_0201  [0201]
R39612  10K  RESISTOR_0201  [0201]
R39613  10K  RESISTOR_0201  [0201]
R39614  10K  RESISTOR_0201  [0201]
R39615  10K  RESISTOR_0201  [0201]
R39616  10K  RESISTOR_0201  [0201]
R39617  10K  RESISTOR_0201  [0201]
R39618  10K  RESISTOR_0201  [0201]
R39619  10K  RESISTOR_0201  [0201]
R39620  10K  RESISTOR_0201  [0201]
R39621  10K  RESISTOR_0201  [0201]
R39622  10K  RESISTOR_0201  [0201]
R39623  10K  RESISTOR_0201  [0201]
R39624  10K  RESISTOR_0201  [0201]
R39625  10K  RESISTOR_0201  [0201]
R39626  10K  RESISTOR_0201  [0201]
R39627  10K  RESISTOR_0201  [0201]
R39628  10K  RESISTOR_0201  [0201]
R39629  10K  RESISTOR_0201  [0201]
R39630  10K  RESISTOR_0201  [0201]
R39631  10K  RESISTOR_0201  [0201]
R39632  10K  RESISTOR_0201  [0201]
R39633  10K  RESISTOR_0201  [0201]
R39634  10K  RESISTOR_0201  [0201]
R39635  10K  RESISTOR_0201  [0201]
R39636  10K  RESISTOR_0201  [0201]
R39637  10K  RESISTOR_0201  [0201]
R39638  10K  RESISTOR_0201  [0201]
R39639  10K  RESISTOR_0201  [0201]
R39640  10K  RESISTOR_0201  [0201]
R39641  10K  RESISTOR_0201  [0201]
R39642  10K  RESISTOR_0201  [0201]
R39643  10K  RESISTOR_0201  [0201]
R39644  10K  RESISTOR_0201  [0201]
R39645  10K  RESISTOR_0201  [0201]
R39646  10K  RESISTOR_0201  [0201]
R39647  10K  RESISTOR_0201  [0201]
R39648  10K  RESISTOR_0201  [0201]
R39649  10K  RESISTOR_0201  [0201]
R39650  10K  RESISTOR_0201  [0201]
R39651  10K  RESISTOR_0201  [0201]
R39652  10K  RESISTOR_0201  [0201]
R39653  10K  RESISTOR_0201  [0201]
R39654  10K  RESISTOR_0201  [0201]
R39655  10K  RESISTOR_0201  [0201]
R39656  10K  RESISTOR_0201  [0201]
R39657  10K  RESISTOR_0201  [0201]
R39658  10K  RESISTOR_0201  [0201]
R39659  10K  RESISTOR_0201  [0201]
R39660  10K  RESISTOR_0201  [0201]
R39661  10K  RESISTOR_0201  [0201]
R39662  10K  RESISTOR_0201  [0201]
R39663  10K  RESISTOR_0201  [0201]
R39664  10K  RESISTOR_0201  [0201]
R39665  10K  RESISTOR_0201  [0201]
R39666  10K  RESISTOR_0201  [0201]
R39667  10K  RESISTOR_0201  [0201]
R39668  10K  RESISTOR_0201  [0201]
R39669  10K  RESISTOR_0201  [0201]
R39670  10K  RESISTOR_0201  [0201]
R39671  10K  RESISTOR_0201  [0201]
R39672  10K  RESISTOR_0201  [0201]
R39673  10K  RESISTOR_0201  [0201]
R39674  10K  RESISTOR_0201  [0201]
R39675  10K  RESISTOR_0201  [0201]
R39676  10K  RESISTOR_0201  [0201]
R39677  10K  RESISTOR_0201  [0201]
R39678  10K  RESISTOR_0201  [0201]
R39679  10K  RESISTOR_0201  [0201]
R39680  10K  RESISTOR_0201  [0201]
R39681  10K  RESISTOR_0201  [0201]
R39682  10K  RESISTOR_0201  [0201]
R39683  10K  RESISTOR_0201  [0201]
R39684  10K  RESISTOR_0201  [0201]
R39685  10K  RESISTOR_0201  [0201]
R39686  10K  RESISTOR_0201  [0201]
R39687  10K  RESISTOR_0201  [0201]
R39688  10K  RESISTOR_0201  [0201]
R39689  10K  RESISTOR_0201  [0201]
R39690  10K  RESISTOR_0201  [0201]
R39691  10K  RESISTOR_0201  [0201]
R39692  10K  RESISTOR_0201  [0201]
R39693  10K  RESISTOR_0201  [0201]
R39694  10K  RESISTOR_0201  [0201]
R39695  10K  RESISTOR_0201  [0201]
R39696  10K  RESISTOR_0201  [0201]
R39697  10K  RESISTOR_0201  [0201]
R39698  10K  RESISTOR_0201  [0201]
R39699  10K  RESISTOR_0201  [0201]
R39700  10K  RESISTOR_0201  [0201]
R39701  10K  RESISTOR_0201  [0201]
R39702  10K  RESISTOR_0201  [0201]
R39703  10K  RESISTOR_0201  [0201]
R39704  10K  RESISTOR_0201  [0201]
R39705  10K  RESISTOR_0201  [0201]
R39706  10K  RESISTOR_0201  [0201]
R39707  10K  RESISTOR_0201  [0201]
R39708  10K  RESISTOR_0201  [0201]
R39709  10K  RESISTOR_0201  [0201]
R39710  10K  RESISTOR_0201  [0201]
R39711  10K  RESISTOR_0201  [0201]
R39712  10K  RESISTOR_0201  [0201]
R39713  10K  RESISTOR_0201  [0201]
R39714  10K  RESISTOR_0201  [0201]
R39715  10K  RESISTOR_0201  [0201]
R39716  10K  RESISTOR_0201  [0201]
R39717  10K  RESISTOR_0201  [0201]
R39718  10K  RESISTOR_0201  [0201]
R39719  10K  RESISTOR_0201  [0201]
R39720  10K  RESISTOR_0201  [0201]
R39721  10K  RESISTOR_0201  [0201]
R39722  10K  RESISTOR_0201  [0201]
R39723  10K  RESISTOR_0201  [0201]
R39724  10K  RESISTOR_0201  [0201]
R39725  10K  RESISTOR_0201  [0201]
R39726  10K  RESISTOR_0201  [0201]
R39727  10K  RESISTOR_0201  [0201]
R39728  10K  RESISTOR_0201  [0201]
R39729  10K  RESISTOR_0201  [0201]
R39730  10K  RESISTOR_0201  [0201]
R39731  10K  RESISTOR_0201  [0201]
R39732  10K  RESISTOR_0201  [0201]
R39733  10K  RESISTOR_0201  [0201]
R39734  10K  RESISTOR_0201  [0201]
R39735  10K  RESISTOR_0201  [0201]
R39736  10K  RESISTOR_0201  [0201]
R39737  10K  RESISTOR_0201  [0201]
R39738  10K  RESISTOR_0201  [0201]
R39739  10K  RESISTOR_0201  [0201]
R39740  10K  RESISTOR_0201  [0201]
R39741  10K  RESISTOR_0201  [0201]
R39742  10K  RESISTOR_0201  [0201]
R39743  10K  RESISTOR_0201  [0201]
R39744  10K  RESISTOR_0201  [0201]
R39745  10K  RESISTOR_0201  [0201]
R39746  10K  RESISTOR_0201  [0201]
R39747  10K  RESISTOR_0201  [0201]
R39748  10K  RESISTOR_0201  [0201]
R39749  10K  RESISTOR_0201  [0201]
R39750  10K  RESISTOR_0201  [0201]
R39751  10K  RESISTOR_0201  [0201]
R39752  10K  RESISTOR_0201  [0201]
R39753  10K  RESISTOR_0201  [0201]
R39754  10K  RESISTOR_0201  [0201]
R39755  10K  RESISTOR_0201  [0201]
R39756  10K  RESISTOR_0201  [0201]
R39757  10K  RESISTOR_0201  [0201]
R39758  10K  RESISTOR_0201  [0201]
R39759  10K  RESISTOR_0201  [0201]
R39760  10K  RESISTOR_0201  [0201]
R39761  10K  RESISTOR_0201  [0201]
R39762  10K  RESISTOR_0201  [0201]
R39763  10K  RESISTOR_0201  [0201]
R39764  10K  RESISTOR_0201  [0201]
R39765  10K  RESISTOR_0201  [0201]
R39766  10K  RESISTOR_0201  [0201]
R39767  10K  RESISTOR_0201  [0201]
R39768  10K  RESISTOR_0201  [0201]
R39769  10K  RESISTOR_0201  [0201]
R39770  10K  RESISTOR_0201  [0201]
R39771  10K  RESISTOR_0201  [0201]
R39772  10K  RESISTOR_0201  [0201]
R39773  10K  RESISTOR_0201  [0201]
R39774  10K  RESISTOR_0201  [0201]
R39775  10K  RESISTOR_0201  [0201]
R39776  10K  RESISTOR_0201  [0201]
R39777  10K  RESISTOR_0201  [0201]
R39778  10K  RESISTOR_0201  [0201]
R39779  10K  RESISTOR_0201  [0201]
R39780  10K  RESISTOR_0201  [0201]
R39781  10K  RESISTOR_0201  [0201]
R39782  10K  RESISTOR_0201  [0201]
R39783  10K  RESISTOR_0201  [0201]
R39784  10K  RESISTOR_0201  [0201]
R39785  10K  RESISTOR_0201  [0201]
R39786  10K  RESISTOR_0201  [0201]
R39787  10K  RESISTOR_0201  [0201]
R39788  10K  RESISTOR_0201  [0201]
R39789  10K  RESISTOR_0201  [0201]
R39790  10K  RESISTOR_0201  [0201]
R39791  10K  RESISTOR_0201  [0201]
R39792  10K  RESISTOR_0201  [0201]
R39793  10K  RESISTOR_0201  [0201]
R39794  10K  RESISTOR_0201  [0201]
R39795  10K  RESISTOR_0201  [0201]
R39796  10K  RESISTOR_0201  [0201]
R39797  10K  RESISTOR_0201  [0201]
R39798  10K  RESISTOR_0201  [0201]
R39799  10K  RESISTOR_0201  [0201]
R39800  10K  RESISTOR_0201  [0201]
R39801  10K  RESISTOR_0201  [0201]
R39802  10K  RESISTOR_0201  [0201]
R39803  10K  RESISTOR_0201  [0201]
R39804  10K  RESISTOR_0201  [0201]
R39805  10K  RESISTOR_0201  [0201]
R39806  10K  RESISTOR_0201  [0201]
R39807  10K  RESISTOR_0201  [0201]
R39808  10K  RESISTOR_0201  [0201]
R39809  10K  RESISTOR_0201  [0201]
R39810  10K  RESISTOR_0201  [0201]
R39811  10K  RESISTOR_0201  [0201]
R39812  10K  RESISTOR_0201  [0201]
R39813  10K  RESISTOR_0201  [0201]
R39814  10K  RESISTOR_0201  [0201]
R39815  10K  RESISTOR_0201  [0201]
R39816  10K  RESISTOR_0201  [0201]
R39817  10K  RESISTOR_0201  [0201]
R39818  10K  RESISTOR_0201  [0201]
R39819  10K  RESISTOR_0201  [0201]
R39820  10K  RESISTOR_0201  [0201]
R39821  10K  RESISTOR_0201  [0201]
R39822  10K  RESISTOR_0201  [0201]
R39823  10K  RESISTOR_0201  [0201]
R39824  10K  RESISTOR_0201  [0201]
R39825  10K  RESISTOR_0201  [0201]
R39826  10K  RESISTOR_0201  [0201]
R39827  10K  RESISTOR_0201  [0201]
R39828  10K  RESISTOR_0201  [0201]
R39829  10K  RESISTOR_0201  [0201]
R39830  10K  RESISTOR_0201  [0201]
R39831  10K  RESISTOR_0201  [0201]
R39832  10K  RESISTOR_0201  [0201]
R39833  10K  RESISTOR_0201  [0201]
R39834  10K  RESISTOR_0201  [0201]
R39835  10K  RESISTOR_0201  [0201]
R39836  10K  RESISTOR_0201  [0201]
R39837  10K  RESISTOR_0201  [0201]
R39838  10K  RESISTOR_0201  [0201]
R39839  10K  RESISTOR_0201  [0201]
R39840  10K  RESISTOR_0201  [0201]
R39841  10K  RESISTOR_0201  [0201]
R39842  10K  RESISTOR_0201  [0201]
R39843  10K  RESISTOR_0201  [0201]
R39844  10K  RESISTOR_0201  [0201]
R39845  10K  RESISTOR_0201  [0201]
R39846  10K  RESISTOR_0201  [0201]
R39847  10K  RESISTOR_0201  [0201]
R39848  10K  RESISTOR_0201  [0201]
R39849  10K  RESISTOR_0201  [0201]
R39850  10K  RESISTOR_0201  [0201]
R39851  10K  RESISTOR_0201  [0201]
R39852  10K  RESISTOR_0201  [0201]
R39853  10K  RESISTOR_0201  [0201]
R39854  10K  RESISTOR_0201  [0201]
R39855  10K  RESISTOR_0201  [0201]
R39856  10K  RESISTOR_0201  [0201]
R39857  10K  RESISTOR_0201  [0201]
R39858  10K  RESISTOR_0201  [0201]
R39859  10K  RESISTOR_0201  [0201]
R39860  10K  RESISTOR_0201  [0201]
R39861  10K  RESISTOR_0201  [0201]
R39862  10K  RESISTOR_0201  [0201]
R39863  10K  RESISTOR_0201  [0201]
R39864  10K  RESISTOR_0201  [0201]
R39865  10K  RESISTOR_0201  [0201]
R39866  10K  RESISTOR_0201  [0201]
R39867  10K  RESISTOR_0201  [0201]
R39868  10K  RESISTOR_0201  [0201]
R39869  10K  RESISTOR_0201  [0201]
R39870  10K  RESISTOR_0201  [0201]
R39871  10K  RESISTOR_0201  [0201]
R39872  10K  RESISTOR_0201  [0201]
R39873  10K  RESISTOR_0201  [0201]
R39874  10K  RESISTOR_0201  [0201]
R39875  10K  RESISTOR_0201  [0201]
R39876  10K  RESISTOR_0201  [0201]
R39877  10K  RESISTOR_0201  [0201]
R39878  10K  RESISTOR_0201  [0201]
R39879  10K  RESISTOR_0201  [0201]
R39880  10K  RESISTOR_0201  [0201]
R39881  10K  RESISTOR_0201  [0201]
R39882  10K  RESISTOR_0201  [0201]
R39883  10K  RESISTOR_0201  [0201]
R39884  10K  RESISTOR_0201  [0201]
R39885  10K  RESISTOR_0201  [0201]
R39886  10K  RESISTOR_0201  [0201]
R39887  10K  RESISTOR_0201  [0201]
R39888  10K  RESISTOR_0201  [0201]
R39889  10K  RESISTOR_0201  [0201]
R39890  10K  RESISTOR_0201  [0201]
R39891  10K  RESISTOR_0201  [0201]
R39892  10K  RESISTOR_0201  [0201]
R39893  10K  RESISTOR_0201  [0201]
R39894  10K  RESISTOR_0201  [0201]
R39895  10K  RESISTOR_0201  [0201]
R39896  10K  RESISTOR_0201  [0201]
R39897  10K  RESISTOR_0201  [0201]
R39898  10K  RESISTOR_0201  [0201]
R39899  10K  RESISTOR_0201  [0201]
R39900  10K  RESISTOR_0201  [0201]
R39901  10K  RESISTOR_0201  [0201]
R39902  10K  RESISTOR_0201  [0201]
R39903  10K  RESISTOR_0201  [0201]
R39904  10K  RESISTOR_0201  [0201]
R39905  10K  RESISTOR_0201  [0201]
R39906  10K  RESISTOR_0201  [0201]
R39907  10K  RESISTOR_0201  [0201]
R39908  10K  RESISTOR_0201  [0201]
R39909  10K  RESISTOR_0201  [0201]
R39910  10K  RESISTOR_0201  [0201]
R39911  10K  RESISTOR_0201  [0201]
R39912  10K  RESISTOR_0201  [0201]
R39913  10K  RESISTOR_0201  [0201]
R39914  10K  RESISTOR_0201  [0201]
R39915  10K  RESISTOR_0201  [0201]
R39916  10K  RESISTOR_0201  [0201]
R39917  10K  RESISTOR_0201  [0201]
R39918  10K  RESISTOR_0201  [0201]
R39919  10K  RESISTOR_0201  [0201]
R39920  10K  RESISTOR_0201  [0201]
R39921  10K  RESISTOR_0201  [0201]
R39922  10K  RESISTOR_0201  [0201]
R39923  10K  RESISTOR_0201  [0201]
R39924  10K  RESISTOR_0201  [0201]
R39925  10K  RESISTOR_0201  [0201]
R39926  10K  RESISTOR_0201  [0201]
R39927  10K  RESISTOR_0201  [0201]
R39928  10K  RESISTOR_0201  [0201]
R39929  10K  RESISTOR_0201  [0201]
R39930  10K  RESISTOR_0201  [0201]
R39931  10K  RESISTOR_0201  [0201]
R39932  10K  RESISTOR_0201  [0201]
R39933  10K  RESISTOR_0201  [0201]
R39934  10K  RESISTOR_0201  [0201]
R39935  10K  RESISTOR_0201  [0201]
R39936  10K  RESISTOR_0201  [0201]
R39937  10K  RESISTOR_0201  [0201]
R39938  10K  RESISTOR_0201  [0201]
R39939  10K  RESISTOR_0201  [0201]
R39940  10K  RESISTOR_0201  [0201]
R39941  10K  RESISTOR_0201  [0201]
R39942  10K  RESISTOR_0201  [0201]
R39943  10K  RESISTOR_0201  [0201]
R39944  10K  RESISTOR_0201  [0201]
R39945  10K  RESISTOR_0201  [0201]
R39946  10K  RESISTOR_0201  [0201]
R39947  10K  RESISTOR_0201  [0201]
R39948  10K  RESISTOR_0201  [0201]
R39949  10K  RESISTOR_0201  [0201]
R39950  10K  RESISTOR_0201  [0201]
R39951  10K  RESISTOR_0201  [0201]
R39952  10K  RESISTOR_0201  [0201]
R39953  10K  RESISTOR_0201  [0201]
R39954  10K  RESISTOR_0201  [0201]
R39955  10K  RESISTOR_0201  [0201]
R39956  10K  RESISTOR_0201  [0201]
R39957  10K  RESISTOR_0201  [0201]
R39958  10K  RESISTOR_0201  [0201]
R39959  10K  RESISTOR_0201  [0201]
R39960  10K  RESISTOR_0201  [0201]
R39961  10K  RESISTOR_0201  [0201]
R39962  10K  RESISTOR_0201  [0201]
R39963  10K  RESISTOR_0201  [0201]
R39964  10K  RESISTOR_0201  [0201]
R39965  10K  RESISTOR_0201  [0201]
R39966  10K  RESISTOR_0201  [0201]
R39967  10K  RESISTOR_0201  [0201]
R39968  10K  RESISTOR_0201  [0201]
R39969  10K  RESISTOR_0201  [0201]
R39970  10K  RESISTOR_0201  [0201]
R39971  10K  RESISTOR_0201  [0201]
R39972  10K  RESISTOR_0201  [0201]
R39973  10K  RESISTOR_0201  [0201]
R39974  10K  RESISTOR_0201  [0201]
R39975  10K  RESISTOR_0201  [0201]
R39976  10K  RESISTOR_0201  [0201]
R39977  10K  RESISTOR_0201  [0201]
R39978  10K  RESISTOR_0201  [0201]
R39979  10K  RESISTOR_0201  [0201]
R39980  10K  RESISTOR_0201  [0201]
R39981  10K  RESISTOR_0201  [0201]
R39982  10K  RESISTOR_0201  [0201]
R39983  10K  RESISTOR_0201  [0201]
R39984  10K  RESISTOR_0201  [0201]
R39985  10K  RESISTOR_0201  [0201]
R39986  10K  RESISTOR_0201  [0201]
R39987  10K  RESISTOR_0201  [0201]
R39988  10K  RESISTOR_0201  [0201]
R39989  10K  RESISTOR_0201  [0201]
R39990  10K  RESISTOR_0201  [0201]
R39991  10K  RESISTOR_0201  [0201]
R39992  10K  RESISTOR_0201  [0201]
R39993  10K  RESISTOR_0201  [0201]
R39994  10K  RESISTOR_0201  [0201]
R39995  10K  RESISTOR_0201  [0201]
R39996  10K  RESISTOR_0201  [0201]
R39997  10K  RESISTOR_0201  [0201]
R39998  10K  RESISTOR_0201  [0201]
R39999  10K  RESISTOR_0201  [0201]
R40000  10K  RESISTOR_0201  [0201]

## Nets